# EAGLE schematic Resistor_Resistor (EAGLE 8.3.0), part 30 of 43 (continued)
## Nets (continued)
N$30: R4601.2 R4602.2 R4603.2 R4604.2 R4605.2 R4606.2 R4607.2 R4608.2 R4609.2 R4610.2 R4611.2 R4612.2 R4613.2 R4614.2 R4615.2 R4616.2 R4617.2 R4618.2 R4619.2 R4620.2 R4621.2 R4622.2 R4623.2 R4624.2 R4625.2 R4626.2 R4627.2 R4628.2 R4629.2 R4630.2 R4631.2 R4632.2 R4633.2 R4634.2 R4635.2 R4636.2 R4637.2 R4638.2 R4639.2 R4640.2 R4641.2 R4642.2 R4643.2 R4644.2 R4645.2 R4646.2 R4647.2 R4648.2 R4649.2 R4650.2 R4651.2 R4652.2 R4653.2 R4654.2 R4655.2 R4656.2 R4657.2 R4658.2 R4659.2 R4660.2 R4661.2 R4662.2 R4663.2 R4664.2 R4665.2 R4666.2 R4667.2 R4668.2 R4669.2 R4670.2 R4671.2 R4672.2 R4673.2 R4674.2 R4675.2 R4676.2 R4677.2 R4678.2 R4679.2 R4680.2 R4681.2 R4682.2 R4683.2 R4684.2 R4685.2 R4686.2 R4687.2 R4688.2 R4689.2 R4690.2 R4691.2 R4692.2 R4693.2 R4694.2 R4695.2 R4696.2 R4697.2 R4698.2 R4699.2 R4700.2 R4701.2 R4702.2 R4703.2 R4704.2 R4705.2 R4706.2 R4707.2 R4708.2 R4709.2 R4710.2 R4711.2 R4712.2 R4713.2 R4714.2 R4715.2 R4716.2 R4717.2 R4718.2 R4719.2 R4720.2 R4721.2 R4722.2 R4723.2 R4724.2 R4725.2 R4726.2 R4727.2 R4728.2 R4729.2 R4730.2 R4731.2 R4732.2 R4733.2 R4734.2 R4735.2 R4736.2 R4737.2 R4738.2 R4739.2 R4740.2 R4741.2 R4742.2 R4743.2 R4744.2 R4745.2 R4746.2 R4747.2 R4748.2 R4749.2 R4750.2 R4751.2 R4752.2 R4753.2 R4754.2 R4755.2 R4756.2 R4757.2 R4758.2 R4759.2 R4760.2 R4761.2 R4762.2 R4763.2 R4764.2 R4765.2 R4766.2 R4767.2 R4768.2 R4769.2 R4770.2 R4771.2 R4772.2 R4773.2 R4774.2 R4775.2 R4776.2 R4777.2 R4778.2 R4779.2 R4780.2 R4781.2 R4782.2 R4783.2 R4784.2 R4785.2 R4786.2 R4787.2 R4788.2 R4789.2 R4790.2 R4791.2 R4792.2 R4793.2 R4794.2 R4795.2 R4796.2 R4797.2 R4798.2 R4799.2 R4800.2 R4801.1 R4802.1 R4803.1 R4804.1 R4805.1 R4806.1 R4807.1 R4808.1 R4809.1 R4810.1 R4811.1 R4812.1 R4813.1 R4814.1 R4815.1 R4816.1 R4817.1 R4818.1 R4819.1 R4820.1 R4821.1 R4822.1 R4823.1 R4824.1 R4825.1 R4826.1 R4827.1 R4828.1 R4829.1 R4830.1 R4831.1 R4832.1 R4833.1 R4834.1 R4835.1 R4836.1 R4837.1 R4838.1 R4839.1 R4840.1 R4841.1 R4842.1 R4843.1 R4844.1 R4845.1 R4846.1 R4847.1 R4848.1 R4849.1 R4850.1 R4851.1 R4852.1 R4853.1 R4854.1 R4855.1 R4856.1 R4857.1 R4858.1 R4859.1 R4860.1 R4861.1 R4862.1 R4863.1 R4864.1 R4865.1 R4866.1 R4867.1 R4868.1 R4869.1 R4870.1 R4871.1 R4872.1 R4873.1 R4874.1 R4875.1 R4876.1 R4877.1 R4878.1 R4879.1 R4880.1 R4881.1 R4882.1 R4883.1 R4884.1 R4885.1 R4886.1 R4887.1 R4888.1 R4889.1 R4890.1 R4891.1 R4892.1 R4893.1 R4894.1 R4895.1 R4896.1 R4897.1 R4898.1 R4899.1 R4900.1 R4901.1 R4902.1 R4903.1 R4904.1 R4905.1 R4906.1 R4907.1 R4908.1 R4909.1 R4910.1 R4911.1 R4912.1 R4913.1 R4914.1 R4915.1 R4916.1 R4917.1 R4918.1 R4919.1 R4920.1 R4921.1 R4922.1 R4923.1 R4924.1 R4925.1 R4926.1 R4927.1 R4928.1 R4929.1 R4930.1 R4931.1 R4932.1 R4933.1 R4934.1 R4935.1 R4936.1 R4937.1 R4938.1 R4939.1 R4940.1 R4941.1 R4942.1 R4943.1 R4944.1 R4945.1 R4946.1 R4947.1 R4948.1 R4949.1 R4950.1 R4951.1 R4952.1 R4953.1 R4954.1 R4955.1 R4956.1 R4957.1 R4958.1 R4959.1 R4960.1 R4961.1 R4962.1 R4963.1 R4964.1 R4965.1 R4966.1 R4967.1 R4968.1 R4969.1 R4970.1 R4971.1 R4972.1 R4973.1 R4974.1 R4975.1 R4976.1 R4977.1 R4978.1 R4979.1 R4980.1 R4981.1 R4982.1 R4983.1 R4984.1 R4985.1 R4986.1 R4987.1 R4988.1 R4989.1 R4990.1 R4991.1 R4992.1 R4993.1 R4994.1 R4995.1 R4996.1 R4997.1 R4998.1 R4999.1 R5000.1
N$31: R4801.2 R4802.2 R4803.2 R4804.2 R4805.2 R4806.2 R4807.2 R4808.2 R4809.2 R4810.2 R4811.2 R4812.2 R4813.2 R4814.2 R4815.2 R4816.2 R4817.2 R4818.2 R4819.2 R4820.2 R4821.2 R4822.2 R4823.2 R4824.2 R4825.2 R4826.2 R4827.2 R4828.2 R4829.2 R4830.2 R4831.2 R4832.2 R4833.2 R4834.2 R4835.2 R4836.2 R4837.2 R4838.2 R4839.2 R4840.2 R4841.2 R4842.2 R4843.2 R4844.2 R4845.2 R4846.2 R4847.2 R4848.2 R4849.2 R4850.2 R4851.2 R4852.2 R4853.2 R4854.2 R4855.2 R4856.2 R4857.2 R4858.2 R4859.2 R4860.2 R4861.2 R4862.2 R4863.2 R4864.2 R4865.2 R4866.2 R4867.2 R4868.2 R4869.2 R4870.2 R4871.2 R4872.2 R4873.2 R4874.2 R4875.2 R4876.2 R4877.2 R4878.2 R4879.2 R4880.2 R4881.2 R4882.2 R4883.2 R4884.2 R4885.2 R4886.2 R4887.2 R4888.2 R4889.2 R4890.2 R4891.2 R4892.2 R4893.2 R4894.2 R4895.2 R4896.2 R4897.2 R4898.2 R4899.2 R4900.2 R4901.2 R4902.2 R4903.2 R4904.2 R4905.2 R4906.2 R4907.2 R4908.2 R4909.2 R4910.2 R4911.2 R4912.2 R4913.2 R4914.2 R4915.2 R4916.2 R4917.2 R4918.2 R4919.2 R4920.2 R4921.2 R4922.2 R4923.2 R4924.2 R4925.2 R4926.2 R4927.2 R4928.2 R4929.2 R4930.2 R4931.2 R4932.2 R4933.2 R4934.2 R4935.2 R4936.2 R4937.2 R4938.2 R4939.2 R4940.2 R4941.2 R4942.2 R4943.2 R4944.2 R4945.2 R4946.2 R4947.2 R4948.2 R4949.2 R4950.2 R4951.2 R4952.2 R4953.2 R4954.2 R4955.2 R4956.2 R4957.2 R4958.2 R4959.2 R4960.2 R4961.2 R4962.2 R4963.2 R4964.2 R4965.2 R4966.2 R4967.2 R4968.2 R4969.2 R4970.2 R4971.2 R4972.2 R4973.2 R4974.2 R4975.2 R4976.2 R4977.2 R4978.2 R4979.2 R4980.2 R4981.2 R4982.2 R4983.2 R4984.2 R4985.2 R4986.2 R4987.2 R4988.2 R4989.2 R4990.2 R4991.2 R4992.2 R4993.2 R4994.2 R4995.2 R4996.2 R4997.2 R4998.2 R4999.2 R5000.2 R5001.1 R5002.1 R5003.1 R5004.1 R5005.1 R5006.1 R5007.1 R5008.1 R5009.1 R5010.1 R5011.1 R5012.1 R5013.1 R5014.1 R5015.1 R5016.1 R5017.1 R5018.1 R5019.1 R5020.1 R5021.1 R5022.1 R5023.1 R5024.1 R5025.1 R5026.1 R5027.1 R5028.1 R5029.1 R5030.1 R5031.1 R5032.1 R5033.1 R5034.1 R5035.1 R5036.1 R5037.1 R5038.1 R5039.1 R5040.1 R5041.1 R5042.1 R5043.1 R5044.1 R5045.1 R5046.1 R5047.1 R5048.1 R5049.1 R5050.1 R5051.1 R5052.1 R5053.1 R5054.1 R5055.1 R5056.1 R5057.1 R5058.1 R5059.1 R5060.1 R5061.1 R5062.1 R5063.1 R5064.1 R5065.1 R5066.1 R5067.1 R5068.1 R5069.1 R5070.1 R5071.1 R5072.1 R5073.1 R5074.1 R5075.1 R5076.1 R5077.1 R5078.1 R5079.1 R5080.1 R5081.1 R5082.1 R5083.1 R5084.1 R5085.1 R5086.1 R5087.1 R5088.1 R5089.1 R5090.1 R5091.1 R5092.1 R5093.1 R5094.1 R5095.1 R5096.1 R5097.1 R5098.1 R5099.1 R5100.1 R5101.1 R5102.1 R5103.1 R5104.1 R5105.1 R5106.1 R5107.1 R5108.1 R5109.1 R5110.1 R5111.1 R5112.1 R5113.1 R5114.1 R5115.1 R5116.1 R5117.1 R5118.1 R5119.1 R5120.1 R5121.1 R5122.1 R5123.1 R5124.1 R5125.1 R5126.1 R5127.1 R5128.1 R5129.1 R5130.1 R5131.1 R5132.1 R5133.1 R5134.1 R5135.1 R5136.1 R5137.1 R5138.1 R5139.1 R5140.1 R5141.1 R5142.1 R5143.1 R5144.1 R5145.1 R5146.1 R5147.1 R5148.1 R5149.1 R5150.1 R5151.1 R5152.1 R5153.1 R5154.1 R5155.1 R5156.1 R5157.1 R5158.1 R5159.1 R5160.1 R5161.1 R5162.1 R5163.1 R5164.1 R5165.1 R5166.1 R5167.1 R5168.1 R5169.1 R5170.1 R5171.1 R5172.1 R5173.1 R5174.1 R5175.1 R5176.1 R5177.1 R5178.1 R5179.1 R5180.1 R5181.1 R5182.1 R5183.1 R5184.1 R5185.1 R5186.1 R5187.1 R5188.1 R5189.1 R5190.1 R5191.1 R5192.1 R5193.1 R5194.1 R5195.1 R5196.1 R5197.1 R5198.1 R5199.1 R5200.1
N$32: R5001.2 R5002.2 R5003.2 R5004.2 R5005.2 R5006.2 R5007.2 R5008.2 R5009.2 R5010.2 R5011.2 R5012.2 R5013.2 R5014.2 R5015.2 R5016.2 R5017.2 R5018.2 R5019.2 R5020.2 R5021.2 R5022.2 R5023.2 R5024.2 R5025.2 R5026.2 R5027.2 R5028.2 R5029.2 R5030.2 R5031.2 R5032.2 R5033.2 R5034.2 R5035.2 R5036.2 R5037.2 R5038.2 R5039.2 R5040.2 R5041.2 R5042.2 R5043.2 R5044.2 R5045.2 R5046.2 R5047.2 R5048.2 R5049.2 R5050.2 R5051.2 R5052.2 R5053.2 R5054.2 R5055.2 R5056.2 R5057.2 R5058.2 R5059.2 R5060.2 R5061.2 R5062.2 R5063.2 R5064.2 R5065.2 R5066.2 R5067.2 R5068.2 R5069.2 R5070.2 R5071.2 R5072.2 R5073.2 R5074.2 R5075.2 R5076.2 R5077.2 R5078.2 R5079.2 R5080.2 R5081.2 R5082.2 R5083.2 R5084.2 R5085.2 R5086.2 R5087.2 R5088.2 R5089.2 R5090.2 R5091.2 R5092.2 R5093.2 R5094.2 R5095.2 R5096.2 R5097.2 R5098.2 R5099.2 R5100.2 R5101.2 R5102.2 R5103.2 R5104.2 R5105.2 R5106.2 R5107.2 R5108.2 R5109.2 R5110.2 R5111.2 R5112.2 R5113.2 R5114.2 R5115.2 R5116.2 R5117.2 R5118.2 R5119.2 R5120.2 R5121.2 R5122.2 R5123.2 R5124.2 R5125.2 R5126.2 R5127.2 R5128.2 R5129.2 R5130.2 R5131.2 R5132.2 R5133.2 R5134.2 R5135.2 R5136.2 R5137.2 R5138.2 R5139.2 R5140.2 R5141.2 R5142.2 R5143.2 R5144.2 R5145.2 R5146.2 R5147.2 R5148.2 R5149.2 R5150.2 R5151.2 R5152.2 R5153.2 R5154.2 R5155.2 R5156.2 R5157.2 R5158.2 R5159.2 R5160.2 R5161.2 R5162.2 R5163.2 R5164.2 R5165.2 R5166.2 R5167.2 R5168.2 R5169.2 R5170.2 R5171.2 R5172.2 R5173.2 R5174.2 R5175.2 R5176.2 R5177.2 R5178.2 R5179.2 R5180.2 R5181.2 R5182.2 R5183.2 R5184.2 R5185.2 R5186.2 R5187.2 R5188.2 R5189.2 R5190.2 R5191.2 R5192.2 R5193.2 R5194.2 R5195.2 R5196.2 R5197.2 R5198.2 R5199.2 R5200.2 R5201.1 R5202.1 R5203.1 R5204.1 R5205.1 R5206.1 R5207.1 R5208.1 R5209.1 R5210.1 R5211.1 R5212.1 R5213.1 R5214.1 R5215.1 R5216.1 R5217.1 R5218.1 R5219.1 R5220.1 R5221.1 R5222.1 R5223.1 R5224.1 R5225.1 R5226.1 R5227.1 R5228.1 R5229.1 R5230.1 R5231.1 R5232.1 R5233.1 R5234.1 R5235.1 R5236.1 R5237.1 R5238.1 R5239.1 R5240.1 R5241.1 R5242.1 R5243.1 R5244.1 R5245.1 R5246.1 R5247.1 R5248.1 R5249.1 R5250.1 R5251.1 R5252.1 R5253.1 R5254.1 R5255.1 R5256.1 R5257.1 R5258.1 R5259.1 R5260.1 R5261.1 R5262.1 R5263.1 R5264.1 R5265.1 R5266.1 R5267.1 R5268.1 R5269.1 R5270.1 R5271.1 R5272.1 R5273.1 R5274.1 R5275.1 R5276.1 R5277.1 R5278.1 R5279.1 R5280.1 R5281.1 R5282.1 R5283.1 R5284.1 R5285.1 R5286.1 R5287.1 R5288.1 R5289.1 R5290.1 R5291.1 R5292.1 R5293.1 R5294.1 R5295.1 R5296.1 R5297.1 R5298.1 R5299.1 R5300.1 R5301.1 R5302.1 R5303.1 R5304.1 R5305.1 R5306.1 R5307.1 R5308.1 R5309.1 R5310.1 R5311.1 R5312.1 R5313.1 R5314.1 R5315.1 R5316.1 R5317.1 R5318.1 R5319.1 R5320.1 R5321.1 R5322.1 R5323.1 R5324.1 R5325.1 R5326.1 R5327.1 R5328.1 R5329.1 R5330.1 R5331.1 R5332.1 R5333.1 R5334.1 R5335.1 R5336.1 R5337.1 R5338.1 R5339.1 R5340.1 R5341.1 R5342.1 R5343.1 R5344.1 R5345.1 R5346.1 R5347.1 R5348.1 R5349.1 R5350.1 R5351.1 R5352.1 R5353.1 R5354.1 R5355.1 R5356.1 R5357.1 R5358.1 R5359.1 R5360.1 R5361.1 R5362.1 R5363.1 R5364.1 R5365.1 R5366.1 R5367.1 R5368.1 R5369.1 R5370.1 R5371.1 R5372.1 R5373.1 R5374.1 R5375.1 R5376.1 R5377.1 R5378.1 R5379.1 R5380.1 R5381.1 R5382.1 R5383.1 R5384.1 R5385.1 R5386.1 R5387.1 R5388.1 R5389.1 R5390.1 R5391.1 R5392.1 R5393.1 R5394.1 R5395.1 R5396.1 R5397.1 R5398.1 R5399.1 R5400.1
N$33: R5201.2 R5202.2 R5203.2 R5204.2 R5205.2 R5206.2 R5207.2 R5208.2 R5209.2 R5210.2 R5211.2 R5212.2 R5213.2 R5214.2 R5215.2 R5216.2 R5217.2 R5218.2 R5219.2 R5220.2 R5221.2 R5222.2 R5223.2 R5224.2 R5225.2 R5226.2 R5227.2 R5228.2 R5229.2 R5230.2 R5231.2 R5232.2 R5233.2 R5234.2 R5235.2 R5236.2 R5237.2 R5238.2 R5239.2 R5240.2 R5241.2 R5242.2 R5243.2 R5244.2 R5245.2 R5246.2 R5247.2 R5248.2 R5249.2 R5250.2 R5251.2 R5252.2 R5253.2 R5254.2 R5255.2 R5256.2 R5257.2 R5258.2 R5259.2 R5260.2 R5261.2 R5262.2 R5263.2 R5264.2 R5265.2 R5266.2 R5267.2 R5268.2 R5269.2 R5270.2 R5271.2 R5272.2 R5273.2 R5274.2 R5275.2 R5276.2 R5277.2 R5278.2 R5279.2 R5280.2 R5281.2 R5282.2 R5283.2 R5284.2 R5285.2 R5286.2 R5287.2 R5288.2 R5289.2 R5290.2 R5291.2 R5292.2 R5293.2 R5294.2 R5295.2 R5296.2 R5297.2 R5298.2 R5299.2 R5300.2 R5301.2 R5302.2 R5303.2 R5304.2 R5305.2 R5306.2 R5307.2 R5308.2 R5309.2 R5310.2 R5311.2 R5312.2 R5313.2 R5314.2 R5315.2 R5316.2 R5317.2 R5318.2 R5319.2 R5320.2 R5321.2 R5322.2 R5323.2 R5324.2 R5325.2 R5326.2 R5327.2 R5328.2 R5329.2 R5330.2 R5331.2 R5332.2 R5333.2 R5334.2 R5335.2 R5336.2 R5337.2 R5338.2 R5339.2 R5340.2 R5341.2 R5342.2 R5343.2 R5344.2 R5345.2 R5346.2 R5347.2 R5348.2 R5349.2 R5350.2 R5351.2 R5352.2 R5353.2 R5354.2 R5355.2 R5356.2 R5357.2 R5358.2 R5359.2 R5360.2 R5361.2 R5362.2 R5363.2 R5364.2 R5365.2 R5366.2 R5367.2 R5368.2 R5369.2 R5370.2 R5371.2 R5372.2 R5373.2 R5374.2 R5375.2 R5376.2 R5377.2 R5378.2 R5379.2 R5380.2 R5381.2 R5382.2 R5383.2 R5384.2 R5385.2 R5386.2 R5387.2 R5388.2 R5389.2 R5390.2 R5391.2 R5392.2 R5393.2 R5394.2 R5395.2 R5396.2 R5397.2 R5398.2 R5399.2 R5400.2 R5401.1 R5402.1 R5403.1 R5404.1 R5405.1 R5406.1 R5407.1 R5408.1 R5409.1 R5410.1 R5411.1 R5412.1 R5413.1 R5414.1 R5415.1 R5416.1 R5417.1 R5418.1 R5419.1 R5420.1 R5421.1 R5422.1 R5423.1 R5424.1 R5425.1 R5426.1 R5427.1 R5428.1 R5429.1 R5430.1 R5431.1 R5432.1 R5433.1 R5434.1 R5435.1 R5436.1 R5437.1 R5438.1 R5439.1 R5440.1 R5441.1 R5442.1 R5443.1 R5444.1 R5445.1 R5446.1 R5447.1 R5448.1 R5449.1 R5450.1 R5451.1 R5452.1 R5453.1 R5454.1 R5455.1 R5456.1 R5457.1 R5458.1 R5459.1 R5460.1 R5461.1 R5462.1 R5463.1 R5464.1 R5465.1 R5466.1 R5467.1 R5468.1 R5469.1 R5470.1 R5471.1 R5472.1 R5473.1 R5474.1 R5475.1 R5476.1 R5477.1 R5478.1 R5479.1 R5480.1 R5481.1 R5482.1 R5483.1 R5484.1 R5485.1 R5486.1 R5487.1 R5488.1 R5489.1 R5490.1 R5491.1 R5492.1 R5493.1 R5494.1 R5495.1 R5496.1 R5497.1 R5498.1 R5499.1 R5500.1 R5501.1 R5502.1 R5503.1 R5504.1 R5505.1 R5506.1 R5507.1 R5508.1 R5509.1 R5510.1 R5511.1 R5512.1 R5513.1 R5514.1 R5515.1 R5516.1 R5517.1 R5518.1 R5519.1 R5520.1 R5521.1 R5522.1 R5523.1 R5524.1 R5525.1 R5526.1 R5527.1 R5528.1 R5529.1 R5530.1 R5531.1 R5532.1 R5533.1 R5534.1 R5535.1 R5536.1 R5537.1 R5538.1 R5539.1 R5540.1 R5541.1 R5542.1 R5543.1 R5544.1 R5545.1 R5546.1 R5547.1 R5548.1 R5549.1 R5550.1 R5551.1 R5552.1 R5553.1 R5554.1 R5555.1 R5556.1 R5557.1 R5558.1 R5559.1 R5560.1 R5561.1 R5562.1 R5563.1 R5564.1 R5565.1 R5566.1 R5567.1 R5568.1 R5569.1 R5570.1 R5571.1 R5572.1 R5573.1 R5574.1 R5575.1 R5576.1 R5577.1 R5578.1 R5579.1 R5580.1 R5581.1 R5582.1 R5583.1 R5584.1 R5585.1 R5586.1 R5587.1 R5588.1 R5589.1 R5590.1 R5591.1 R5592.1 R5593.1 R5594.1 R5595.1 R5596.1 R5597.1 R5598.1 R5599.1 R5600.1
N$34: R5401.2 R5402.2 R5403.2 R5404.2 R5405.2 R5406.2 R5407.2 R5408.2 R5409.2 R5410.2 R5411.2 R5412.2 R5413.2 R5414.2 R5415.2 R5416.2 R5417.2 R5418.2 R5419.2 R5420.2 R5421.2 R5422.2 R5423.2 R5424.2 R5425.2 R5426.2 R5427.2 R5428.2 R5429.2 R5430.2 R5431.2 R5432.2 R5433.2 R5434.2 R5435.2 R5436.2 R5437.2 R5438.2 R5439.2 R5440.2 R5441.2 R5442.2 R5443.2 R5444.2 R5445.2 R5446.2 R5447.2 R5448.2 R5449.2 R5450.2 R5451.2 R5452.2 R5453.2 R5454.2 R5455.2 R5456.2 R5457.2 R5458.2 R5459.2 R5460.2 R5461.2 R5462.2 R5463.2 R5464.2 R5465.2 R5466.2 R5467.2 R5468.2 R5469.2 R5470.2 R5471.2 R5472.2 R5473.2 R5474.2 R5475.2 R5476.2 R5477.2 R5478.2 R5479.2 R5480.2 R5481.2 R5482.2 R5483.2 R5484.2 R5485.2 R5486.2 R5487.2 R5488.2 R5489.2 R5490.2 R5491.2 R5492.2 R5493.2 R5494.2 R5495.2 R5496.2 R5497.2 R5498.2 R5499.2 R5500.2 R5501.2 R5502.2 R5503.2 R5504.2 R5505.2 R5506.2 R5507.2 R5508.2 R5509.2 R5510.2 R5511.2 R5512.2 R5513.2 R5514.2 R5515.2 R5516.2 R5517.2 R5518.2 R5519.2 R5520.2 R5521.2 R5522.2 R5523.2 R5524.2 R5525.2 R5526.2 R5527.2 R5528.2 R5529.2 R5530.2 R5531.2 R5532.2 R5533.2 R5534.2 R5535.2 R5536.2 R5537.2 R5538.2 R5539.2 R5540.2 R5541.2 R5542.2 R5543.2 R5544.2 R5545.2 R5546.2 R5547.2 R5548.2 R5549.2 R5550.2 R5551.2 R5552.2 R5553.2 R5554.2 R5555.2 R5556.2 R5557.2 R5558.2 R5559.2 R5560.2 R5561.2 R5562.2 R5563.2 R5564.2 R5565.2 R5566.2 R5567.2 R5568.2 R5569.2 R5570.2 R5571.2 R5572.2 R5573.2 R5574.2 R5575.2 R5576.2 R5577.2 R5578.2 R5579.2 R5580.2 R5581.2 R5582.2 R5583.2 R5584.2 R5585.2 R5586.2 R5587.2 R5588.2 R5589.2 R5590.2 R5591.2 R5592.2 R5593.2 R5594.2 R5595.2 R5596.2 R5597.2 R5598.2 R5599.2 R5600.2 R5601.1 R5602.1 R5603.1 R5604.1 R5605.1 R5606.1 R5607.1 R5608.1 R5609.1 R5610.1 R5611.1 R5612.1 R5613.1 R5614.1 R5615.1 R5616.1 R5617.1 R5618.1 R5619.1 R5620.1 R5621.1 R5622.1 R5623.1 R5624.1 R5625.1 R5626.1 R5627.1 R5628.1 R5629.1 R5630.1 R5631.1 R5632.1 R5633.1 R5634.1 R5635.1 R5636.1 R5637.1 R5638.1 R5639.1 R5640.1 R5641.1 R5642.1 R5643.1 R5644.1 R5645.1 R5646.1 R5647.1 R5648.1 R5649.1 R5650.1 R5651.1 R5652.1 R5653.1 R5654.1 R5655.1 R5656.1 R5657.1 R5658.1 R5659.1 R5660.1 R5661.1 R5662.1 R5663.1 R5664.1 R5665.1 R5666.1 R5667.1 R5668.1 R5669.1 R5670.1 R5671.1 R5672.1 R5673.1 R5674.1 R5675.1 R5676.1 R5677.1 R5678.1 R5679.1 R5680.1 R5681.1 R5682.1 R5683.1 R5684.1 R5685.1 R5686.1 R5687.1 R5688.1 R5689.1 R5690.1 R5691.1 R5692.1 R5693.1 R5694.1 R5695.1 R5696.1 R5697.1 R5698.1 R5699.1 R5700.1 R5701.1 R5702.1 R5703.1 R5704.1 R5705.1 R5706.1 R5707.1 R5708.1 R5709.1 R5710.1 R5711.1 R5712.1 R5713.1 R5714.1 R5715.1 R5716.1 R5717.1 R5718.1 R5719.1 R5720.1 R5721.1 R5722.1 R5723.1 R5724.1 R5725.1 R5726.1 R5727.1 R5728.1 R5729.1 R5730.1 R5731.1 R5732.1 R5733.1 R5734.1 R5735.1 R5736.1 R5737.1 R5738.1 R5739.1 R5740.1 R5741.1 R5742.1 R5743.1 R5744.1 R5745.1 R5746.1 R5747.1 R5748.1 R5749.1 R5750.1 R5751.1 R5752.1 R5753.1 R5754.1 R5755.1 R5756.1 R5757.1 R5758.1 R5759.1 R5760.1 R5761.1 R5762.1 R5763.1 R5764.1 R5765.1 R5766.1 R5767.1 R5768.1 R5769.1 R5770.1 R5771.1 R5772.1 R5773.1 R5774.1 R5775.1 R5776.1 R5777.1 R5778.1 R5779.1 R5780.1 R5781.1 R5782.1 R5783.1 R5784.1 R5785.1 R5786.1 R5787.1 R5788.1 R5789.1 R5790.1 R5791.1 R5792.1 R5793.1 R5794.1 R5795.1 R5796.1 R5797.1 R5798.1 R5799.1 R5800.1
N$35: R5601.2 R5602.2 R5603.2 R5604.2 R5605.2 R5606.2 R5607.2 R5608.2 R5609.2 R5610.2 R5611.2 R5612.2 R5613.2 R5614.2 R5615.2 R5616.2 R5617.2 R5618.2 R5619.2 R5620.2 R5621.2 R5622.2 R5623.2 R5624.2 R5625.2 R5626.2 R5627.2 R5628.2 R5629.2 R5630.2 R5631.2 R5632.2 R5633.2 R5634.2 R5635.2 R5636.2 R5637.2 R5638.2 R5639.2 R5640.2 R5641.2 R5642.2 R5643.2 R5644.2 R5645.2 R5646.2 R5647.2 R5648.2 R5649.2 R5650.2 R5651.2 R5652.2 R5653.2 R5654.2 R5655.2 R5656.2 R5657.2 R5658.2 R5659.2 R5660.2 R5661.2 R5662.2 R5663.2 R5664.2 R5665.2 R5666.2 R5667.2 R5668.2 R5669.2 R5670.2 R5671.2 R5672.2 R5673.2 R5674.2 R5675.2 R5676.2 R5677.2 R5678.2 R5679.2 R5680.2 R5681.2 R5682.2 R5683.2 R5684.2 R5685.2 R5686.2 R5687.2 R5688.2 R5689.2 R5690.2 R5691.2 R5692.2 R5693.2 R5694.2 R5695.2 R5696.2 R5697.2 R5698.2 R5699.2 R5700.2 R5701.2 R5702.2 R5703.2 R5704.2 R5705.2 R5706.2 R5707.2 R5708.2 R5709.2 R5710.2 R5711.2 R5712.2 R5713.2 R5714.2 R5715.2 R5716.2 R5717.2 R5718.2 R5719.2 R5720.2 R5721.2 R5722.2 R5723.2 R5724.2 R5725.2 R5726.2 R5727.2 R5728.2 R5729.2 R5730.2 R5731.2 R5732.2 R5733.2 R5734.2 R5735.2 R5736.2 R5737.2 R5738.2 R5739.2 R5740.2 R5741.2 R5742.2 R5743.2 R5744.2 R5745.2 R5746.2 R5747.2 R5748.2 R5749.2 R5750.2 R5751.2 R5752.2 R5753.2 R5754.2 R5755.2 R5756.2 R5757.2 R5758.2 R5759.2 R5760.2 R5761.2 R5762.2 R5763.2 R5764.2 R5765.2 R5766.2 R5767.2 R5768.2 R5769.2 R5770.2 R5771.2 R5772.2 R5773.2 R5774.2 R5775.2 R5776.2 R5777.2 R5778.2 R5779.2 R5780.2 R5781.2 R5782.2 R5783.2 R5784.2 R5785.2 R5786.2 R5787.2 R5788.2 R5789.2 R5790.2 R5791.2 R5792.2 R5793.2 R5794.2 R5795.2 R5796.2 R5797.2 R5798.2 R5799.2 R5800.2 R5801.1 R5802.1 R5803.1 R5804.1 R5805.1 R5806.1 R5807.1 R5808.1 R5809.1 R5810.1 R5811.1 R5812.1 R5813.1 R5814.1 R5815.1 R5816.1 R5817.1 R5818.1 R5819.1 R5820.1 R5821.1 R5822.1 R5823.1 R5824.1 R5825.1 R5826.1 R5827.1 R5828.1 R5829.1 R5830.1 R5831.1 R5832.1 R5833.1 R5834.1 R5835.1 R5836.1 R5837.1 R5838.1 R5839.1 R5840.1 R5841.1 R5842.1 R5843.1 R5844.1 R5845.1 R5846.1 R5847.1 R5848.1 R5849.1 R5850.1 R5851.1 R5852.1 R5853.1 R5854.1 R5855.1 R5856.1 R5857.1 R5858.1 R5859.1 R5860.1 R5861.1 R5862.1 R5863.1 R5864.1 R5865.1 R5866.1 R5867.1 R5868.1 R5869.1 R5870.1 R5871.1 R5872.1 R5873.1 R5874.1 R5875.1 R5876.1 R5877.1 R5878.1 R5879.1 R5880.1 R5881.1 R5882.1 R5883.1 R5884.1 R5885.1 R5886.1 R5887.1 R5888.1 R5889.1 R5890.1 R5891.1 R5892.1 R5893.1 R5894.1 R5895.1 R5896.1 R5897.1 R5898.1 R5899.1 R5900.1 R5901.1 R5902.1 R5903.1 R5904.1 R5905.1 R5906.1 R5907.1 R5908.1 R5909.1 R5910.1 R5911.1 R5912.1 R5913.1 R5914.1 R5915.1 R5916.1 R5917.1 R5918.1 R5919.1 R5920.1 R5921.1 R5922.1 R5923.1 R5924.1 R5925.1 R5926.1 R5927.1 R5928.1 R5929.1 R5930.1 R5931.1 R5932.1 R5933.1 R5934.1 R5935.1 R5936.1 R5937.1 R5938.1 R5939.1 R5940.1 R5941.1 R5942.1 R5943.1 R5944.1 R5945.1 R5946.1 R5947.1 R5948.1 R5949.1 R5950.1 R5951.1 R5952.1 R5953.1 R5954.1 R5955.1 R5956.1 R5957.1 R5958.1 R5959.1 R5960.1 R5961.1 R5962.1 R5963.1 R5964.1 R5965.1 R5966.1 R5967.1 R5968.1 R5969.1 R5970.1 R5971.1 R5972.1 R5973.1 R5974.1 R5975.1 R5976.1 R5977.1 R5978.1 R5979.1 R5980.1 R5981.1 R5982.1 R5983.1 R5984.1 R5985.1 R5986.1 R5987.1 R5988.1 R5989.1 R5990.1 R5991.1 R5992.1 R5993.1 R5994.1 R5995.1 R5996.1 R5997.1 R5998.1 R5999.1 R6000.1
N$36: R5801.2 R5802.2 R5803.2 R5804.2 R5805.2 R5806.2 R5807.2 R5808.2 R5809.2 R5810.2 R5811.2 R5812.2 R5813.2 R5814.2 R5815.2 R5816.2 R5817.2 R5818.2 R5819.2 R5820.2 R5821.2 R5822.2 R5823.2 R5824.2 R5825.2 R5826.2 R5827.2 R5828.2 R5829.2 R5830.2 R5831.2 R5832.2 R5833.2 R5834.2 R5835.2 R5836.2 R5837.2 R5838.2 R5839.2 R5840.2 R5841.2 R5842.2 R5843.2 R5844.2 R5845.2 R5846.2 R5847.2 R5848.2 R5849.2 R5850.2 R5851.2 R5852.2 R5853.2 R5854.2 R5855.2 R5856.2 R5857.2 R5858.2 R5859.2 R5860.2 R5861.2 R5862.2 R5863.2 R5864.2 R5865.2 R5866.2 R5867.2 R5868.2 R5869.2 R5870.2 R5871.2 R5872.2 R5873.2 R5874.2 R5875.2 R5876.2 R5877.2 R5878.2 R5879.2 R5880.2 R5881.2 R5882.2 R5883.2 R5884.2 R5885.2 R5886.2 R5887.2 R5888.2 R5889.2 R5890.2 R5891.2 R5892.2 R5893.2 R5894.2 R5895.2 R5896.2 R5897.2 R5898.2 R5899.2 R5900.2 R5901.2 R5902.2 R5903.2 R5904.2 R5905.2 R5906.2 R5907.2 R5908.2 R5909.2 R5910.2 R5911.2 R5912.2 R5913.2 R5914.2 R5915.2 R5916.2 R5917.2 R5918.2 R5919.2 R5920.2 R5921.2 R5922.2 R5923.2 R5924.2 R5925.2 R5926.2 R5927.2 R5928.2 R5929.2 R5930.2 R5931.2 R5932.2 R5933.2 R5934.2 R5935.2 R5936.2 R5937.2 R5938.2 R5939.2 R5940.2 R5941.2 R5942.2 R5943.2 R5944.2 R5945.2 R5946.2 R5947.2 R5948.2 R5949.2 R5950.2 R5951.2 R5952.2 R5953.2 R5954.2 R5955.2 R5956.2 R5957.2 R5958.2 R5959.2 R5960.2 R5961.2 R5962.2 R5963.2 R5964.2 R5965.2 R5966.2 R5967.2 R5968.2 R5969.2 R5970.2 R5971.2 R5972.2 R5973.2 R5974.2 R5975.2 R5976.2 R5977.2 R5978.2 R5979.2 R5980.2 R5981.2 R5982.2 R5983.2 R5984.2 R5985.2 R5986.2 R5987.2 R5988.2 R5989.2 R5990.2 R5991.2 R5992.2 R5993.2 R5994.2 R5995.2 R5996.2 R5997.2 R5998.2 R5999.2 R6000.2 R6001.1 R6002.1 R6003.1 R6004.1 R6005.1 R6006.1 R6007.1 R6008.1 R6009.1 R6010.1 R6011.1 R6012.1 R6013.1 R6014.1 R6015.1 R6016.1 R6017.1 R6018.1 R6019.1 R6020.1 R6021.1 R6022.1 R6023.1 R6024.1 R6025.1 R6026.1 R6027.1 R6028.1 R6029.1 R6030.1 R6031.1 R6032.1 R6033.1 R6034.1 R6035.1 R6036.1 R6037.1 R6038.1 R6039.1 R6040.1 R6041.1 R6042.1 R6043.1 R6044.1 R6045.1 R6046.1 R6047.1 R6048.1 R6049.1 R6050.1 R6051.1 R6052.1 R6053.1 R6054.1 R6055.1 R6056.1 R6057.1 R6058.1 R6059.1 R6060.1 R6061.1 R6062.1 R6063.1 R6064.1 R6065.1 R6066.1 R6067.1 R6068.1 R6069.1 R6070.1 R6071.1 R6072.1 R6073.1 R6074.1 R6075.1 R6076.1 R6077.1 R6078.1 R6079.1 R6080.1 R6081.1 R6082.1 R6083.1 R6084.1 R6085.1 R6086.1 R6087.1 R6088.1 R6089.1 R6090.1 R6091.1 R6092.1 R6093.1 R6094.1 R6095.1 R6096.1 R6097.1 R6098.1 R6099.1 R6100.1 R6101.1 R6102.1 R6103.1 R6104.1 R6105.1 R6106.1 R6107.1 R6108.1 R6109.1 R6110.1 R6111.1 R6112.1 R6113.1 R6114.1 R6115.1 R6116.1 R6117.1 R6118.1 R6119.1 R6120.1 R6121.1 R6122.1 R6123.1 R6124.1 R6125.1 R6126.1 R6127.1 R6128.1 R6129.1 R6130.1 R6131.1 R6132.1 R6133.1 R6134.1 R6135.1 R6136.1 R6137.1 R6138.1 R6139.1 R6140.1 R6141.1 R6142.1 R6143.1 R6144.1 R6145.1 R6146.1 R6147.1 R6148.1 R6149.1 R6150.1 R6151.1 R6152.1 R6153.1 R6154.1 R6155.1 R6156.1 R6157.1 R6158.1 R6159.1 R6160.1 R6161.1 R6162.1 R6163.1 R6164.1 R6165.1 R6166.1 R6167.1 R6168.1 R6169.1 R6170.1 R6171.1 R6172.1 R6173.1 R6174.1 R6175.1 R6176.1 R6177.1 R6178.1 R6179.1 R6180.1 R6181.1 R6182.1 R6183.1 R6184.1 R6185.1 R6186.1 R6187.1 R6188.1 R6189.1 R6190.1 R6191.1 R6192.1 R6193.1 R6194.1 R6195.1 R6196.1 R6197.1 R6198.1 R6199.1 R6200.1